# EAGLE board Resistor_Resistor (EAGLE 8.3.0), part 6 of 32 (continued)
## Placement (x,y rotation side) (continued)
R7210  10K  [0201]  69.24,6.76 0 top
R7211  10K  [0201]  69.24,7.37 0 top
R7212  10K  [0201]  69.24,7.98 0 top
R7213  10K  [0201]  69.24,8.59 0 top
R7214  10K  [0201]  69.24,9.19 0 top
R7215  10K  [0201]  69.24,9.8 0 top
R7216  10K  [0201]  69.24,10.41 0 top
R7217  10K  [0201]  69.24,11.02 0 top
R7218  10K  [0201]  69.24,11.63 0 top
R7219  10K  [0201]  69.24,12.24 0 top
R7220  10K  [0201]  69.24,12.85 0 top
R7221  10K  [0201]  69.24,13.46 0 top
R7222  10K  [0201]  69.24,14.07 0 top
R7223  10K  [0201]  69.24,14.68 0 top
R7224  10K  [0201]  69.24,15.29 0 top
R7225  10K  [0201]  69.24,15.9 0 top
R7226  10K  [0201]  69.24,16.51 0 top
R7227  10K  [0201]  69.24,17.12 0 top
R7228  10K  [0201]  69.24,17.73 0 top
R7229  10K  [0201]  69.24,18.34 0 top
R7230  10K  [0201]  69.24,18.95 0 top
R7231  10K  [0201]  69.24,19.56 0 top
R7232  10K  [0201]  69.24,20.17 0 top
R7233  10K  [0201]  69.24,20.78 0 top
R7234  10K  [0201]  69.24,21.39 0 top
R7235  10K  [0201]  69.24,22 0 top
R7236  10K  [0201]  69.24,22.61 0 top
R7237  10K  [0201]  69.24,23.22 0 top
R7238  10K  [0201]  69.24,23.83 0 top
R7239  10K  [0201]  69.24,24.43 0 top
R7240  10K  [0201]  69.24,25.04 0 top
R7241  10K  [0201]  69.24,25.65 0 top
R7242  10K  [0201]  69.24,26.26 0 top
R7243  10K  [0201]  69.24,26.87 0 top
R7244  10K  [0201]  69.24,27.48 0 top
R7245  10K  [0201]  69.24,28.09 0 top
R7246  10K  [0201]  69.24,28.7 0 top
R7247  10K  [0201]  69.24,29.31 0 top
R7248  10K  [0201]  69.24,29.92 0 top
R7249  10K  [0201]  69.24,30.53 0 top
R7250  10K  [0201]  69.24,31.14 0 top
R7251  10K  [0201]  69.24,31.75 0 top
R7252  10K  [0201]  69.24,32.36 0 top
R7253  10K  [0201]  69.24,32.97 0 top
R7254  10K  [0201]  69.24,33.58 0 top
R7255  10K  [0201]  69.24,34.19 0 top
R7256  10K  [0201]  69.24,34.8 0 top
R7257  10K  [0201]  69.24,35.41 0 top
R7258  10K  [0201]  69.24,36.02 0 top
R7259  10K  [0201]  69.24,36.63 0 top
R7260  10K  [0201]  69.24,37.24 0 top
R7261  10K  [0201]  69.24,37.85 0 top
R7262  10K  [0201]  69.24,38.46 0 top
R7263  10K  [0201]  69.24,39.07 0 top
R7264  10K  [0201]  69.24,39.67 0 top
R7265  10K  [0201]  69.24,40.28 0 top
R7266  10K  [0201]  69.24,40.89 0 top
R7267  10K  [0201]  69.24,41.5 0 top
R7268  10K  [0201]  69.24,42.11 0 top
R7269  10K  [0201]  69.24,42.72 0 top
R7270  10K  [0201]  69.24,43.33 0 top
R7271  10K  [0201]  69.24,43.94 0 top
R7272  10K  [0201]  69.24,44.55 0 top
R7273  10K  [0201]  69.24,45.16 0 top
R7274  10K  [0201]  69.24,45.77 0 top
R7275  10K  [0201]  69.24,46.38 0 top
R7276  10K  [0201]  69.24,46.99 0 top
R7277  10K  [0201]  69.24,47.6 0 top
R7278  10K  [0201]  69.24,48.21 0 top
R7279  10K  [0201]  69.24,48.82 0 top
R7280  10K  [0201]  69.24,49.43 0 top
R7281  10K  [0201]  69.24,50.04 0 top
R7282  10K  [0201]  69.24,50.65 0 top
R7283  10K  [0201]  69.24,51.26 0 top
R7284  10K  [0201]  69.24,51.87 0 top
R7285  10K  [0201]  69.24,52.48 0 top
R7286  10K  [0201]  69.24,53.09 0 top
R7287  10K  [0201]  69.24,53.7 0 top
R7288  10K  [0201]  69.24,54.31 0 top
R7289  10K  [0201]  69.24,54.91 0 top
R7290  10K  [0201]  69.24,55.52 0 top
R7291  10K  [0201]  69.24,56.13 0 top
R7292  10K  [0201]  69.24,56.74 0 top
R7293  10K  [0201]  69.24,57.35 0 top
R7294  10K  [0201]  69.24,57.96 0 top
R7295  10K  [0201]  69.24,58.57 0 top
R7296  10K  [0201]  69.24,59.18 0 top
R7297  10K  [0201]  69.24,59.79 0 top
R7298  10K  [0201]  69.24,60.4 0 top
R7299  10K  [0201]  69.24,61.01 0 top
R7300  10K  [0201]  69.24,61.62 0 top
R7301  10K  [0201]  69.24,62.23 0 top
R7302  10K  [0201]  69.24,62.84 0 top
R7303  10K  [0201]  69.24,63.45 0 top
R7304  10K  [0201]  69.24,64.06 0 top
R7305  10K  [0201]  69.24,64.67 0 top
R7306  10K  [0201]  69.24,65.28 0 top
R7307  10K  [0201]  69.24,65.89 0 top
R7308  10K  [0201]  69.24,66.5 0 top
R7309  10K  [0201]  69.24,67.11 0 top
R7310  10K  [0201]  69.24,67.72 0 top
R7311  10K  [0201]  69.24,68.33 0 top
R7312  10K  [0201]  69.24,68.94 0 top
R7313  10K  [0201]  69.24,69.55 0 top
R7314  10K  [0201]  69.24,70.15 0 top
R7315  10K  [0201]  69.24,70.76 0 top
R7316  10K  [0201]  69.24,71.37 0 top
R7317  10K  [0201]  69.24,71.98 0 top
R7318  10K  [0201]  69.24,72.59 0 top
R7319  10K  [0201]  69.24,73.2 0 top
R7320  10K  [0201]  69.24,73.81 0 top
R7321  10K  [0201]  69.24,74.42 0 top
R7322  10K  [0201]  69.24,75.03 0 top
R7323  10K  [0201]  69.24,75.64 0 top
R7324  10K  [0201]  69.24,76.25 0 top
R7325  10K  [0201]  69.24,76.86 0 top
R7326  10K  [0201]  69.24,77.47 0 top
R7327  10K  [0201]  69.24,78.08 0 top
R7328  10K  [0201]  69.24,78.69 0 top
R7329  10K  [0201]  69.24,79.3 0 top
R7330  10K  [0201]  69.24,79.91 0 top
R7331  10K  [0201]  69.24,80.52 0 top
R7332  10K  [0201]  69.24,81.13 0 top
R7333  10K  [0201]  69.24,81.74 0 top
R7334  10K  [0201]  69.24,82.35 0 top
R7335  10K  [0201]  69.24,82.96 0 top
R7336  10K  [0201]  69.24,83.57 0 top
R7337  10K  [0201]  69.24,84.18 0 top
R7338  10K  [0201]  69.24,84.79 0 top
R7339  10K  [0201]  69.24,85.39 0 top
R7340  10K  [0201]  69.24,86 0 top
R7341  10K  [0201]  69.24,86.61 0 top
R7342  10K  [0201]  69.24,87.22 0 top
R7343  10K  [0201]  69.24,87.83 0 top
R7344  10K  [0201]  69.24,88.44 0 top
R7345  10K  [0201]  69.24,89.05 0 top
R7346  10K  [0201]  69.24,89.66 0 top
R7347  10K  [0201]  69.24,90.27 0 top
R7348  10K  [0201]  69.24,90.88 0 top
R7349  10K  [0201]  69.24,91.49 0 top
R7350  10K  [0201]  69.24,92.1 0 top
R7351  10K  [0201]  69.24,92.71 0 top
R7352  10K  [0201]  69.24,93.32 0 top
R7353  10K  [0201]  69.24,93.93 0 top
R7354  10K  [0201]  69.24,94.54 0 top
R7355  10K  [0201]  69.24,95.15 0 top
R7356  10K  [0201]  69.24,95.76 0 top
R7357  10K  [0201]  69.24,96.37 0 top
R7358  10K  [0201]  69.24,96.98 0 top
R7359  10K  [0201]  69.24,97.59 0 top
R7360  10K  [0201]  69.24,98.2 0 top
R7361  10K  [0201]  69.24,98.81 0 top
R7362  10K  [0201]  69.24,99.42 0 top
R7363  10K  [0201]  69.24,100.03 0 top
R7364  10K  [0201]  69.24,100.63 0 top
R7365  10K  [0201]  69.24,101.24 0 top
R7366  10K  [0201]  69.24,101.85 0 top
R7367  10K  [0201]  69.24,102.46 0 top
R7368  10K  [0201]  69.24,103.07 0 top
R7369  10K  [0201]  69.24,103.68 0 top
R7370  10K  [0201]  69.24,104.29 0 top
R7371  10K  [0201]  69.24,104.9 0 top
R7372  10K  [0201]  69.24,105.51 0 top
R7373  10K  [0201]  69.24,106.12 0 top
R7374  10K  [0201]  69.24,106.73 0 top
R7375  10K  [0201]  69.24,107.34 0 top
R7376  10K  [0201]  69.24,107.95 0 top
R7377  10K  [0201]  69.24,108.56 0 top
R7378  10K  [0201]  69.24,109.17 0 top
R7379  10K  [0201]  69.24,109.78 0 top
R7380  10K  [0201]  69.24,110.39 0 top
R7381  10K  [0201]  69.24,111 0 top
R7382  10K  [0201]  69.24,111.61 0 top
R7383  10K  [0201]  69.24,112.22 0 top
R7384  10K  [0201]  69.24,112.83 0 top
R7385  10K  [0201]  69.24,113.44 0 top
R7386  10K  [0201]  69.24,114.05 0 top
R7387  10K  [0201]  69.24,114.66 0 top
R7388  10K  [0201]  69.24,115.27 0 top
R7389  10K  [0201]  69.24,115.87 0 top
R7390  10K  [0201]  69.24,116.48 0 top
R7391  10K  [0201]  69.24,117.09 0 top
R7392  10K  [0201]  69.24,117.7 0 top
R7393  10K  [0201]  69.24,118.31 0 top
R7394  10K  [0201]  69.24,118.92 0 top
R7395  10K  [0201]  69.24,119.53 0 top
R7396  10K  [0201]  69.24,120.14 0 top
R7397  10K  [0201]  69.24,120.75 0 top
R7398  10K  [0201]  69.24,121.36 0 top
R7399  10K  [0201]  69.24,121.97 0 top
R7400  10K  [0201]  69.24,122.58 0 top
R7401  10K  [0201]  70.46,1.27 0 top
R7402  10K  [0201]  70.46,1.88 0 top
R7403  10K  [0201]  70.46,2.49 0 top
R7404  10K  [0201]  70.46,3.1 0 top
R7405  10K  [0201]  70.46,3.71 0 top
R7406  10K  [0201]  70.46,4.32 0 top
R7407  10K  [0201]  70.46,4.93 0 top
R7408  10K  [0201]  70.46,5.54 0 top
R7409  10K  [0201]  70.46,6.15 0 top
R7410  10K  [0201]  70.46,6.76 0 top
R7411  10K  [0201]  70.46,7.37 0 top
R7412  10K  [0201]  70.46,7.98 0 top
R7413  10K  [0201]  70.46,8.59 0 top
R7414  10K  [0201]  70.46,9.19 0 top
R7415  10K  [0201]  70.46,9.8 0 top
R7416  10K  [0201]  70.46,10.41 0 top
R7417  10K  [0201]  70.46,11.02 0 top
R7418  10K  [0201]  70.46,11.63 0 top
R7419  10K  [0201]  70.46,12.24 0 top
R7420  10K  [0201]  70.46,12.85 0 top
R7421  10K  [0201]  70.46,13.46 0 top
R7422  10K  [0201]  70.46,14.07 0 top
R7423  10K  [0201]  70.46,14.68 0 top
R7424  10K  [0201]  70.46,15.29 0 top
R7425  10K  [0201]  70.46,15.9 0 top
R7426  10K  [0201]  70.46,16.51 0 top
R7427  10K  [0201]  70.46,17.12 0 top
R7428  10K  [0201]  70.46,17.73 0 top
R7429  10K  [0201]  70.46,18.34 0 top
R7430  10K  [0201]  70.46,18.95 0 top
R7431  10K  [0201]  70.46,19.56 0 top
R7432  10K  [0201]  70.46,20.17 0 top
R7433  10K  [0201]  70.46,20.78 0 top
R7434  10K  [0201]  70.46,21.39 0 top
R7435  10K  [0201]  70.46,22 0 top
R7436  10K  [0201]  70.46,22.61 0 top
R7437  10K  [0201]  70.46,23.22 0 top
R7438  10K  [0201]  70.46,23.83 0 top
R7439  10K  [0201]  70.46,24.43 0 top
R7440  10K  [0201]  70.46,25.04 0 top
R7441  10K  [0201]  70.46,25.65 0 top
R7442  10K  [0201]  70.46,26.26 0 top
R7443  10K  [0201]  70.46,26.87 0 top
R7444  10K  [0201]  70.46,27.48 0 top
R7445  10K  [0201]  70.46,28.09 0 top
R7446  10K  [0201]  70.46,28.7 0 top
R7447  10K  [0201]  70.46,29.31 0 top
R7448  10K  [0201]  70.46,29.92 0 top
R7449  10K  [0201]  70.46,30.53 0 top
R7450  10K  [0201]  70.46,31.14 0 top
R7451  10K  [0201]  70.46,31.75 0 top
R7452  10K  [0201]  70.46,32.36 0 top
R7453  10K  [0201]  70.46,32.97 0 top
R7454  10K  [0201]  70.46,33.58 0 top
R7455  10K  [0201]  70.46,34.19 0 top
R7456  10K  [0201]  70.46,34.8 0 top
R7457  10K  [0201]  70.46,35.41 0 top
R7458  10K  [0201]  70.46,36.02 0 top
R7459  10K  [0201]  70.46,36.63 0 top
R7460  10K  [0201]  70.46,37.24 0 top
R7461  10K  [0201]  70.46,37.85 0 top
R7462  10K  [0201]  70.46,38.46 0 top
R7463  10K  [0201]  70.46,39.07 0 top
R7464  10K  [0201]  70.46,39.67 0 top
R7465  10K  [0201]  70.46,40.28 0 top
R7466  10K  [0201]  70.46,40.89 0 top
R7467  10K  [0201]  70.46,41.5 0 top
R7468  10K  [0201]  70.46,42.11 0 top
R7469  10K  [0201]  70.46,42.72 0 top
R7470  10K  [0201]  70.46,43.33 0 top
R7471  10K  [0201]  70.46,43.94 0 top
R7472  10K  [0201]  70.46,44.55 0 top
R7473  10K  [0201]  70.46,45.16 0 top
R7474  10K  [0201]  70.46,45.77 0 top
R7475  10K  [0201]  70.46,46.38 0 top
R7476  10K  [0201]  70.46,46.99 0 top
R7477  10K  [0201]  70.46,47.6 0 top
R7478  10K  [0201]  70.46,48.21 0 top
R7479  10K  [0201]  70.46,48.82 0 top
R7480  10K  [0201]  70.46,49.43 0 top
R7481  10K  [0201]  70.46,50.04 0 top
R7482  10K  [0201]  70.46,50.65 0 top
R7483  10K  [0201]  70.46,51.26 0 top
R7484  10K  [0201]  70.46,51.87 0 top
R7485  10K  [0201]  70.46,52.48 0 top
R7486  10K  [0201]  70.46,53.09 0 top
R7487  10K  [0201]  70.46,53.7 0 top
R7488  10K  [0201]  70.46,54.31 0 top
R7489  10K  [0201]  70.46,54.91 0 top
R7490  10K  [0201]  70.46,55.52 0 top
R7491  10K  [0201]  70.46,56.13 0 top
R7492  10K  [0201]  70.46,56.74 0 top
R7493  10K  [0201]  70.46,57.35 0 top
R7494  10K  [0201]  70.46,57.96 0 top
R7495  10K  [0201]  70.46,58.57 0 top
R7496  10K  [0201]  70.46,59.18 0 top
R7497  10K  [0201]  70.46,59.79 0 top
R7498  10K  [0201]  70.46,60.4 0 top
R7499  10K  [0201]  70.46,61.01 0 top
R7500  10K  [0201]  70.46,61.62 0 top
R7501  10K  [0201]  70.46,62.23 0 top
R7502  10K  [0201]  70.46,62.84 0 top
R7503  10K  [0201]  70.46,63.45 0 top
R7504  10K  [0201]  70.46,64.06 0 top
R7505  10K  [0201]  70.46,64.67 0 top
R7506  10K  [0201]  70.46,65.28 0 top
R7507  10K  [0201]  70.46,65.89 0 top
R7508  10K  [0201]  70.46,66.5 0 top
R7509  10K  [0201]  70.46,67.11 0 top
R7510  10K  [0201]  70.46,67.72 0 top
R7511  10K  [0201]  70.46,68.33 0 top
R7512  10K  [0201]  70.46,68.94 0 top
R7513  10K  [0201]  70.46,69.55 0 top
R7514  10K  [0201]  70.46,70.15 0 top
R7515  10K  [0201]  70.46,70.76 0 top
R7516  10K  [0201]  70.46,71.37 0 top
R7517  10K  [0201]  70.46,71.98 0 top
R7518  10K  [0201]  70.46,72.59 0 top
R7519  10K  [0201]  70.46,73.2 0 top
R7520  10K  [0201]  70.46,73.81 0 top
R7521  10K  [0201]  70.46,74.42 0 top
R7522  10K  [0201]  70.46,75.03 0 top
R7523  10K  [0201]  70.46,75.64 0 top
R7524  10K  [0201]  70.46,76.25 0 top
R7525  10K  [0201]  70.46,76.86 0 top
R7526  10K  [0201]  70.46,77.47 0 top
R7527  10K  [0201]  70.46,78.08 0 top
R7528  10K  [0201]  70.46,78.69 0 top
R7529  10K  [0201]  70.46,79.3 0 top
R7530  10K  [0201]  70.46,79.91 0 top
R7531  10K  [0201]  70.46,80.52 0 top
R7532  10K  [0201]  70.46,81.13 0 top
R7533  10K  [0201]  70.46,81.74 0 top
R7534  10K  [0201]  70.46,82.35 0 top
R7535  10K  [0201]  70.46,82.96 0 top
R7536  10K  [0201]  70.46,83.57 0 top
R7537  10K  [0201]  70.46,84.18 0 top
R7538  10K  [0201]  70.46,84.79 0 top
R7539  10K  [0201]  70.46,85.39 0 top
R7540  10K  [0201]  70.46,86 0 top
R7541  10K  [0201]  70.46,86.61 0 top
R7542  10K  [0201]  70.46,87.22 0 top
R7543  10K  [0201]  70.46,87.83 0 top
R7544  10K  [0201]  70.46,88.44 0 top
R7545  10K  [0201]  70.46,89.05 0 top
R7546  10K  [0201]  70.46,89.66 0 top
R7547  10K  [0201]  70.46,90.27 0 top
R7548  10K  [0201]  70.46,90.88 0 top
R7549  10K  [0201]  70.46,91.49 0 top
R7550  10K  [0201]  70.46,92.1 0 top
R7551  10K  [0201]  70.46,92.71 0 top
R7552  10K  [0201]  70.46,93.32 0 top
R7553  10K  [0201]  70.46,93.93 0 top
R7554  10K  [0201]  70.46,94.54 0 top
R7555  10K  [0201]  70.46,95.15 0 top
R7556  10K  [0201]  70.46,95.76 0 top
R7557  10K  [0201]  70.46,96.37 0 top
R7558  10K  [0201]  70.46,96.98 0 top
R7559  10K  [0201]  70.46,97.59 0 top
R7560  10K  [0201]  70.46,98.2 0 top
R7561  10K  [0201]  70.46,98.81 0 top
R7562  10K  [0201]  70.46,99.42 0 top
R7563  10K  [0201]  70.46,100.03 0 top
R7564  10K  [0201]  70.46,100.63 0 top
R7565  10K  [0201]  70.46,101.24 0 top
R7566  10K  [0201]  70.46,101.85 0 top
R7567  10K  [0201]  70.46,102.46 0 top
R7568  10K  [0201]  70.46,103.07 0 top
R7569  10K  [0201]  70.46,103.68 0 top
R7570  10K  [0201]  70.46,104.29 0 top
R7571  10K  [0201]  70.46,104.9 0 top
R7572  10K  [0201]  70.46,105.51 0 top
R7573  10K  [0201]  70.46,106.12 0 top
R7574  10K  [0201]  70.46,106.73 0 top
R7575  10K  [0201]  70.46,107.34 0 top
R7576  10K  [0201]  70.46,107.95 0 top
R7577  10K  [0201]  70.46,108.56 0 top
R7578  10K  [0201]  70.46,109.17 0 top
R7579  10K  [0201]  70.46,109.78 0 top
R7580  10K  [0201]  70.46,110.39 0 top
R7581  10K  [0201]  70.46,111 0 top
R7582  10K  [0201]  70.46,111.61 0 top
R7583  10K  [0201]  70.46,112.22 0 top
R7584  10K  [0201]  70.46,112.83 0 top
R7585  10K  [0201]  70.46,113.44 0 top
R7586  10K  [0201]  70.46,114.05 0 top
R7587  10K  [0201]  70.46,114.66 0 top
R7588  10K  [0201]  70.46,115.27 0 top
R7589  10K  [0201]  70.46,115.87 0 top
R7590  10K  [0201]  70.46,116.48 0 top
R7591  10K  [0201]  70.46,117.09 0 top
R7592  10K  [0201]  70.46,117.7 0 top
R7593  10K  [0201]  70.46,118.31 0 top
R7594  10K  [0201]  70.46,118.92 0 top
R7595  10K  [0201]  70.46,119.53 0 top
R7596  10K  [0201]  70.46,120.14 0 top
R7597  10K  [0201]  70.46,120.75 0 top
R7598  10K  [0201]  70.46,121.36 0 top
R7599  10K  [0201]  70.46,121.97 0 top
R7600  10K  [0201]  70.46,122.58 0 top
R7601  10K  [0201]  71.68,1.27 0 top
R7602  10K  [0201]  71.68,1.88 0 top
R7603  10K  [0201]  71.68,2.49 0 top
R7604  10K  [0201]  71.68,3.1 0 top
R7605  10K  [0201]  71.68,3.71 0 top
R7606  10K  [0201]  71.68,4.32 0 top
R7607  10K  [0201]  71.68,4.93 0 top
R7608  10K  [0201]  71.68,5.54 0 top
R7609  10K  [0201]  71.68,6.15 0 top
R7610  10K  [0201]  71.68,6.76 0 top
R7611  10K  [0201]  71.68,7.37 0 top
R7612  10K  [0201]  71.68,7.98 0 top
R7613  10K  [0201]  71.68,8.59 0 top
R7614  10K  [0201]  71.68,9.19 0 top
R7615  10K  [0201]  71.68,9.8 0 top
R7616  10K  [0201]  71.68,10.41 0 top
R7617  10K  [0201]  71.68,11.02 0 top
R7618  10K  [0201]  71.68,11.63 0 top
R7619  10K  [0201]  71.68,12.24 0 top
R7620  10K  [0201]  71.68,12.85 0 top
R7621  10K  [0201]  71.68,13.46 0 top
R7622  10K  [0201]  71.68,14.07 0 top
R7623  10K  [0201]  71.68,14.68 0 top
R7624  10K  [0201]  71.68,15.29 0 top
R7625  10K  [0201]  71.68,15.9 0 top
R7626  10K  [0201]  71.68,16.51 0 top
R7627  10K  [0201]  71.68,17.12 0 top
R7628  10K  [0201]  71.68,17.73 0 top
R7629  10K  [0201]  71.68,18.34 0 top
R7630  10K  [0201]  71.68,18.95 0 top
R7631  10K  [0201]  71.68,19.56 0 top
R7632  10K  [0201]  71.68,20.17 0 top
R7633  10K  [0201]  71.68,20.78 0 top
R7634  10K  [0201]  71.68,21.39 0 top
R7635  10K  [0201]  71.68,22 0 top
R7636  10K  [0201]  71.68,22.61 0 top
R7637  10K  [0201]  71.68,23.22 0 top
R7638  10K  [0201]  71.68,23.83 0 top
R7639  10K  [0201]  71.68,24.43 0 top
R7640  10K  [0201]  71.68,25.04 0 top
R7641  10K  [0201]  71.68,25.65 0 top
R7642  10K  [0201]  71.68,26.26 0 top
R7643  10K  [0201]  71.68,26.87 0 top
R7644  10K  [0201]  71.68,27.48 0 top
R7645  10K  [0201]  71.68,28.09 0 top
R7646  10K  [0201]  71.68,28.7 0 top
R7647  10K  [0201]  71.68,29.31 0 top
R7648  10K  [0201]  71.68,29.92 0 top
R7649  10K  [0201]  71.68,30.53 0 top
R7650  10K  [0201]  71.68,31.14 0 top
R7651  10K  [0201]  71.68,31.75 0 top
R7652  10K  [0201]  71.68,32.36 0 top
R7653  10K  [0201]  71.68,32.97 0 top
R7654  10K  [0201]  71.68,33.58 0 top
R7655  10K  [0201]  71.68,34.19 0 top
R7656  10K  [0201]  71.68,34.8 0 top
R7657  10K  [0201]  71.68,35.41 0 top
R7658  10K  [0201]  71.68,36.02 0 top
R7659  10K  [0201]  71.68,36.63 0 top
R7660  10K  [0201]  71.68,37.24 0 top
R7661  10K  [0201]  71.68,37.85 0 top
R7662  10K  [0201]  71.68,38.46 0 top
R7663  10K  [0201]  71.68,39.07 0 top
R7664  10K  [0201]  71.68,39.67 0 top
R7665  10K  [0201]  71.68,40.28 0 top
R7666  10K  [0201]  71.68,40.89 0 top
R7667  10K  [0201]  71.68,41.5 0 top
R7668  10K  [0201]  71.68,42.11 0 top
R7669  10K  [0201]  71.68,42.72 0 top
R7670  10K  [0201]  71.68,43.33 0 top
R7671  10K  [0201]  71.68,43.94 0 top
R7672  10K  [0201]  71.68,44.55 0 top
R7673  10K  [0201]  71.68,45.16 0 top
R7674  10K  [0201]  71.68,45.77 0 top
R7675  10K  [0201]  71.68,46.38 0 top
R7676  10K  [0201]  71.68,46.99 0 top
R7677  10K  [0201]  71.68,47.6 0 top
R7678  10K  [0201]  71.68,48.21 0 top
R7679  10K  [0201]  71.68,48.82 0 top
R7680  10K  [0201]  71.68,49.43 0 top
R7681  10K  [0201]  71.68,50.04 0 top
R7682  10K  [0201]  71.68,50.65 0 top
R7683  10K  [0201]  71.68,51.26 0 top
R7684  10K  [0201]  71.68,51.87 0 top
R7685  10K  [0201]  71.68,52.48 0 top
R7686  10K  [0201]  71.68,53.09 0 top
R7687  10K  [0201]  71.68,53.7 0 top
R7688  10K  [0201]  71.68,54.31 0 top
R7689  10K  [0201]  71.68,54.91 0 top
R7690  10K  [0201]  71.68,55.52 0 top
R7691  10K  [0201]  71.68,56.13 0 top
R7692  10K  [0201]  71.68,56.74 0 top
R7693  10K  [0201]  71.68,57.35 0 top
R7694  10K  [0201]  71.68,57.96 0 top
R7695  10K  [0201]  71.68,58.57 0 top
R7696  10K  [0201]  71.68,59.18 0 top
R7697  10K  [0201]  71.68,59.79 0 top
R7698  10K  [0201]  71.68,60.4 0 top
R7699  10K  [0201]  71.68,61.01 0 top
R7700  10K  [0201]  71.68,61.62 0 top
R7701  10K  [0201]  71.68,62.23 0 top
R7702  10K  [0201]  71.68,62.84 0 top
R7703  10K  [0201]  71.68,63.45 0 top
R7704  10K  [0201]  71.68,64.06 0 top
R7705  10K  [0201]  71.68,64.67 0 top
R7706  10K  [0201]  71.68,65.28 0 top
R7707  10K  [0201]  71.68,65.89 0 top
R7708  10K  [0201]  71.68,66.5 0 top
R7709  10K  [0201]  71.68,67.11 0 top
R7710  10K  [0201]  71.68,67.72 0 top
R7711  10K  [0201]  71.68,68.33 0 top
R7712  10K  [0201]  71.68,68.94 0 top
R7713  10K  [0201]  71.68,69.55 0 top
R7714  10K  [0201]  71.68,70.15 0 top
R7715  10K  [0201]  71.68,70.76 0 top
R7716  10K  [0201]  71.68,71.37 0 top
R7717  10K  [0201]  71.68,71.98 0 top
R7718  10K  [0201]  71.68,72.59 0 top
R7719  10K  [0201]  71.68,73.2 0 top
R7720  10K  [0201]  71.68,73.81 0 top
R7721  10K  [0201]  71.68,74.42 0 top
R7722  10K  [0201]  71.68,75.03 0 top
R7723  10K  [0201]  71.68,75.64 0 top
R7724  10K  [0201]  71.68,76.25 0 top
R7725  10K  [0201]  71.68,76.86 0 top
R7726  10K  [0201]  71.68,77.47 0 top
R7727  10K  [0201]  71.68,78.08 0 top
R7728  10K  [0201]  71.68,78.69 0 top
R7729  10K  [0201]  71.68,79.3 0 top
R7730  10K  [0201]  71.68,79.91 0 top
R7731  10K  [0201]  71.68,80.52 0 top
R7732  10K  [0201]  71.68,81.13 0 top
R7733  10K  [0201]  71.68,81.74 0 top
R7734  10K  [0201]  71.68,82.35 0 top
R7735  10K  [0201]  71.68,82.96 0 top
R7736  10K  [0201]  71.68,83.57 0 top
R7737  10K  [0201]  71.68,84.18 0 top
R7738  10K  [0201]  71.68,84.79 0 top
R7739  10K  [0201]  71.68,85.39 0 top
R7740  10K  [0201]  71.68,86 0 top
R7741  10K  [0201]  71.68,86.61 0 top
R7742  10K  [0201]  71.68,87.22 0 top
R7743  10K  [0201]  71.68,87.83 0 top
R7744  10K  [0201]  71.68,88.44 0 top
R7745  10K  [0201]  71.68,89.05 0 top
R7746  10K  [0201]  71.68,89.66 0 top
R7747  10K  [0201]  71.68,90.27 0 top
R7748  10K  [0201]  71.68,90.88 0 top
R7749  10K  [0201]  71.68,91.49 0 top
R7750  10K  [0201]  71.68,92.1 0 top
R7751  10K  [0201]  71.68,92.71 0 top
R7752  10K  [0201]  71.68,93.32 0 top
R7753  10K  [0201]  71.68,93.93 0 top
R7754  10K  [0201]  71.68,94.54 0 top
R7755  10K  [0201]  71.68,95.15 0 top
R7756  10K  [0201]  71.68,95.76 0 top
R7757  10K  [0201]  71.68,96.37 0 top
R7758  10K  [0201]  71.68,96.98 0 top
R7759  10K  [0201]  71.68,97.59 0 top
R7760  10K  [0201]  71.68,98.2 0 top
R7761  10K  [0201]  71.68,98.81 0 top
R7762  10K  [0201]  71.68,99.42 0 top
R7763  10K  [0201]  71.68,100.03 0 top
R7764  10K  [0201]  71.68,100.63 0 top
R7765  10K  [0201]  71.68,101.24 0 top
R7766  10K  [0201]  71.68,101.85 0 top
R7767  10K  [0201]  71.68,102.46 0 top
R7768  10K  [0201]  71.68,103.07 0 top
R7769  10K  [0201]  71.68,103.68 0 top
R7770  10K  [0201]  71.68,104.29 0 top
R7771  10K  [0201]  71.68,104.9 0 top
R7772  10K  [0201]  71.68,105.51 0 top
R7773  10K  [0201]  71.68,106.12 0 top
R7774  10K  [0201]  71.68,106.73 0 top
R7775  10K  [0201]  71.68,107.34 0 top
R7776  10K  [0201]  71.68,107.95 0 top
R7777  10K  [0201]  71.68,108.56 0 top
R7778  10K  [0201]  71.68,109.17 0 top
R7779  10K  [0201]  71.68,109.78 0 top
R7780  10K  [0201]  71.68,110.39 0 top
R7781  10K  [0201]  71.68,111 0 top
R7782  10K  [0201]  71.68,111.61 0 top
R7783  10K  [0201]  71.68,112.22 0 top
R7784  10K  [0201]  71.68,112.83 0 top
R7785  10K  [0201]  71.68,113.44 0 top
R7786  10K  [0201]  71.68,114.05 0 top
R7787  10K  [0201]  71.68,114.66 0 top
R7788  10K  [0201]  71.68,115.27 0 top
R7789  10K  [0201]  71.68,115.87 0 top
R7790  10K  [0201]  71.68,116.48 0 top
R7791  10K  [0201]  71.68,117.09 0 top
R7792  10K  [0201]  71.68,117.7 0 top
R7793  10K  [0201]  71.68,118.31 0 top
R7794  10K  [0201]  71.68,118.92 0 top
R7795  10K  [0201]  71.68,119.53 0 top
R7796  10K  [0201]  71.68,120.14 0 top
R7797  10K  [0201]  71.68,120.75 0 top
R7798  10K  [0201]  71.68,121.36 0 top
R7799  10K  [0201]  71.68,121.97 0 top
R7800  10K  [0201]  71.68,122.58 0 top
R7801  10K  [0201]  72.9,1.27 0 top
R7802  10K  [0201]  72.9,1.88 0 top
R7803  10K  [0201]  72.9,2.49 0 top
R7804  10K  [0201]  72.9,3.1 0 top
R7805  10K  [0201]  72.9,3.71 0 top
R7806  10K  [0201]  72.9,4.32 0 top
R7807  10K  [0201]  72.9,4.93 0 top
R7808  10K  [0201]  72.9,5.54 0 top
R7809  10K  [0201]  72.9,6.15 0 top
R7810  10K  [0201]  72.9,6.76 0 top
R7811  10K  [0201]  72.9,7.37 0 top
R7812  10K  [0201]  72.9,7.98 0 top
R7813  10K  [0201]  72.9,8.59 0 top
R7814  10K  [0201]  72.9,9.19 0 top
R7815  10K  [0201]  72.9,9.8 0 top
R7816  10K  [0201]  72.9,10.41 0 top
R7817  10K  [0201]  72.9,11.02 0 top
R7818  10K  [0201]  72.9,11.63 0 top
R7819  10K  [0201]  72.9,12.24 0 top
R7820  10K  [0201]  72.9,12.85 0 top
R7821  10K  [0201]  72.9,13.46 0 top
R7822  10K  [0201]  72.9,14.07 0 top
R7823  10K  [0201]  72.9,14.68 0 top
R7824  10K  [0201]  72.9,15.29 0 top
R7825  10K  [0201]  72.9,15.9 0 top
R7826  10K  [0201]  72.9,16.51 0 top
R7827  10K  [0201]  72.9,17.12 0 top
R7828  10K  [0201]  72.9,17.73 0 top
R7829  10K  [0201]  72.9,18.34 0 top
R7830  10K  [0201]  72.9,18.95 0 top
R7831  10K  [0201]  72.9,19.56 0 top
R7832  10K  [0201]  72.9,20.17 0 top
R7833  10K  [0201]  72.9,20.78 0 top
R7834  10K  [0201]  72.9,21.39 0 top
R7835  10K  [0201]  72.9,22 0 top
R7836  10K  [0201]  72.9,22.61 0 top
R7837  10K  [0201]  72.9,23.22 0 top
R7838  10K  [0201]  72.9,23.83 0 top
R7839  10K  [0201]  72.9,24.43 0 top
R7840  10K  [0201]  72.9,25.04 0 top
R7841  10K  [0201]  72.9,25.65 0 top
R7842  10K  [0201]  72.9,26.26 0 top
R7843  10K  [0201]  72.9,26.87 0 top
R7844  10K  [0201]  72.9,27.48 0 top
R7845  10K  [0201]  72.9,28.09 0 top
R7846  10K  [0201]  72.9,28.7 0 top
R7847  10K  [0201]  72.9,29.31 0 top
R7848  10K  [0201]  72.9,29.92 0 top
R7849  10K  [0201]  72.9,30.53 0 top
R7850  10K  [0201]  72.9,31.14 0 top
R7851  10K  [0201]  72.9,31.75 0 top
R7852  10K  [0201]  72.9,32.36 0 top
R7853  10K  [0201]  72.9,32.97 0 top
R7854  10K  [0201]  72.9,33.58 0 top
R7855  10K  [0201]  72.9,34.19 0 top
R7856  10K  [0201]  72.9,34.8 0 top
R7857  10K  [0201]  72.9,35.41 0 top
R7858  10K  [0201]  72.9,36.02 0 top
R7859  10K  [0201]  72.9,36.63 0 top
R7860  10K  [0201]  72.9,37.24 0 top
R7861  10K  [0201]  72.9,37.85 0 top
R7862  10K  [0201]  72.9,38.46 0 top
R7863  10K  [0201]  72.9,39.07 0 top
R7864  10K  [0201]  72.9,39.67 0 top
R7865  10K  [0201]  72.9,40.28 0 top
R7866  10K  [0201]  72.9,40.89 0 top